# EasyEDA Pro project MSDRV3.eprj, board PCB9
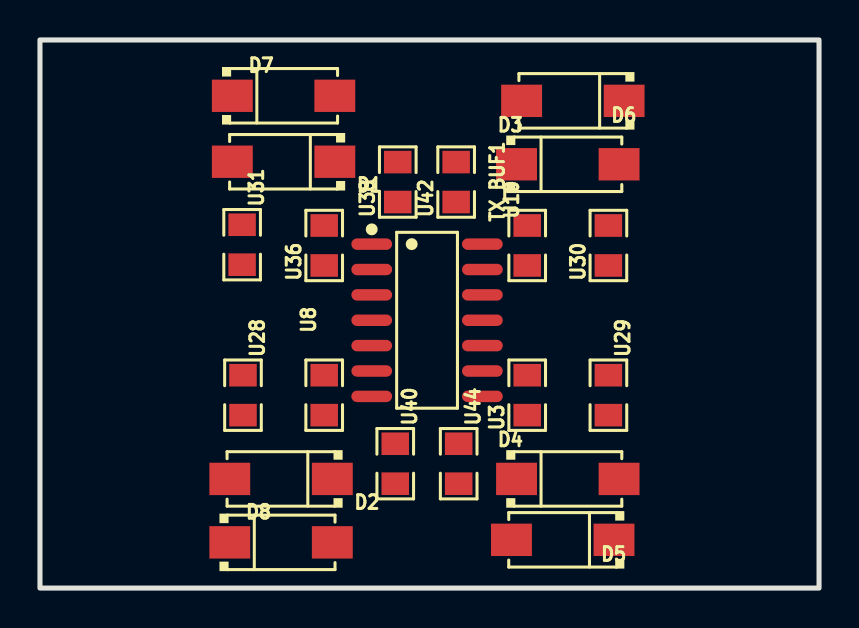
[diagram p16: board, top side]
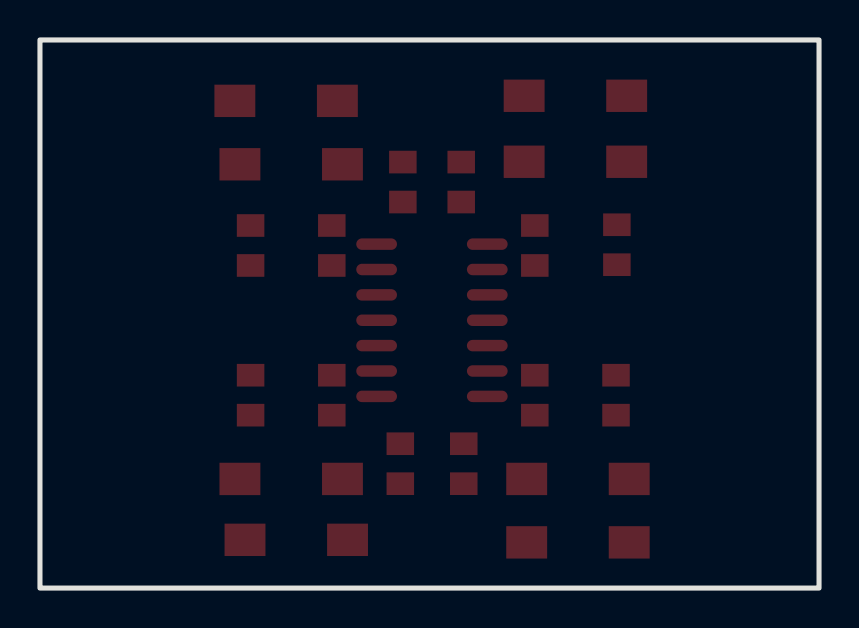
[diagram p17: board, bottom side, seen from below]

Outline 38.99 x 27.43 mm; copper layers: Top Layer, Bottom Layer. Coordinates in mm from the lower left corner of the outline.
Outline path: rectangle 0,27.43 38.99,0
Stack: Top Layer 0.035mm / Dielectric1 1.51mm FR4 er 4.5 / Bottom Layer 0.035mm

## Design rules (mm)
template: Custom Config
spacing copperThickness1oz (default): track to track 0.6, other pairs 0.152 to 0.3
spacing copperThickness2oz: track to track 0.203, other pairs 0.152 to 0.3
track width copperThickness1oz (default): min 0.127, default 0.254, max 2.54
track width copperThickness2oz: min 0.203, default 0.254, max 2.54
differential pair differentialPair (default): width min 0.127, default 0.254, max 2.54; gap min 0.152, default 0.152
via viaSize (default): diameter min 0.5, default 0.61, max 10; hole min 0.3, default 0.305, max 6.299

## Placement (name value [footprint] x y rotation side)
D1  -  [SMA_L4.4-W2.8-LS5.4-RD]  12.19 21.34 180 top
D2  -  [SMA_L4.4-W2.8-LS5.4-RD]  12.06 5.46 180 top
D3  -  [SMA_L4.4-W2.8-LS5.4-RD]  26.42 21.21 0 top
D4  -  [SMA_L4.4-W2.8-LS5.4-RD]  26.42 5.46 0 top
D5  -  [SMA_L4.4-W2.8-LS5.4-RD]  26.16 2.41 180 top
D6  -  [SMA_L4.4-W2.8-LS5.4-RD]  26.67 24.38 180 top
D7  -  [SMA_L4.4-W2.8-LS5.4-RD]  12.19 24.64 0 top
D8  -  [SMA_L4.4-W2.8-LS5.4-RD]  12.06 2.29 0 top
TX_BUF1  CLC4601ISO14X  [SOIC-14_L8.7-W3.9-P1.27-LS6.0-BL]  19.37 13.4 270 top
U3  1120  [R0805]  24.38 9.65 90 top
U8  1120  [R0805]  14.22 9.65 270 top
U10  1120  [R0805]  24.38 17.14 270 top
U28  1120  [R0805]  10.16 9.65 270 top
U29  1120  [R0805]  28.45 9.65 270 top
U30  1120  [R0805]  28.45 17.14 90 top
U31  1120  [R0805]  10.12 17.18 270 top
U36  1120  [R0805]  14.22 17.14 90 top
U38  1120  [R0805]  17.91 20.32 90 top
U40  1120  [R0805]  17.78 6.22 270 top
U42  1120  [R0805]  20.83 20.32 90 top
U44  1120  [R0805]  20.96 6.22 270 top

## Footprints (pads in the part's own frame, mm; a bottom-side part is the same pattern mirrored in y, then rotated)
R0805
  rect 1.133x1.377 smd: 1(-1,0) 2(1,0)
SMA_L4.4-W2.8-LS5.4-RD
  rect 2.046x1.62 smd: 1(-2.566,0) 2(2.566,0)
SOIC-14_L8.7-W3.9-P1.27-LS6.0-BL
  oval 0.574x2.038 smd: 1(-3.81,-2.769) 2(-2.54,-2.769) 3(-1.27,-2.769) 4(0,-2.769) 5(1.27,-2.769) 6(2.54,-2.769) 7(3.81,-2.769) 8(3.81,2.769) 9(2.54,2.769) 10(1.27,2.769) 11(0,2.769) 12(-1.27,2.769) 13(-2.54,2.769) 14(-3.81,2.769)

## Nets
As in the schematic.
